# EasyEDA Pro project BlueberryPi.eprj, schematic BlueberryPi Board, sheets 1 to 8 of 13 (continued)
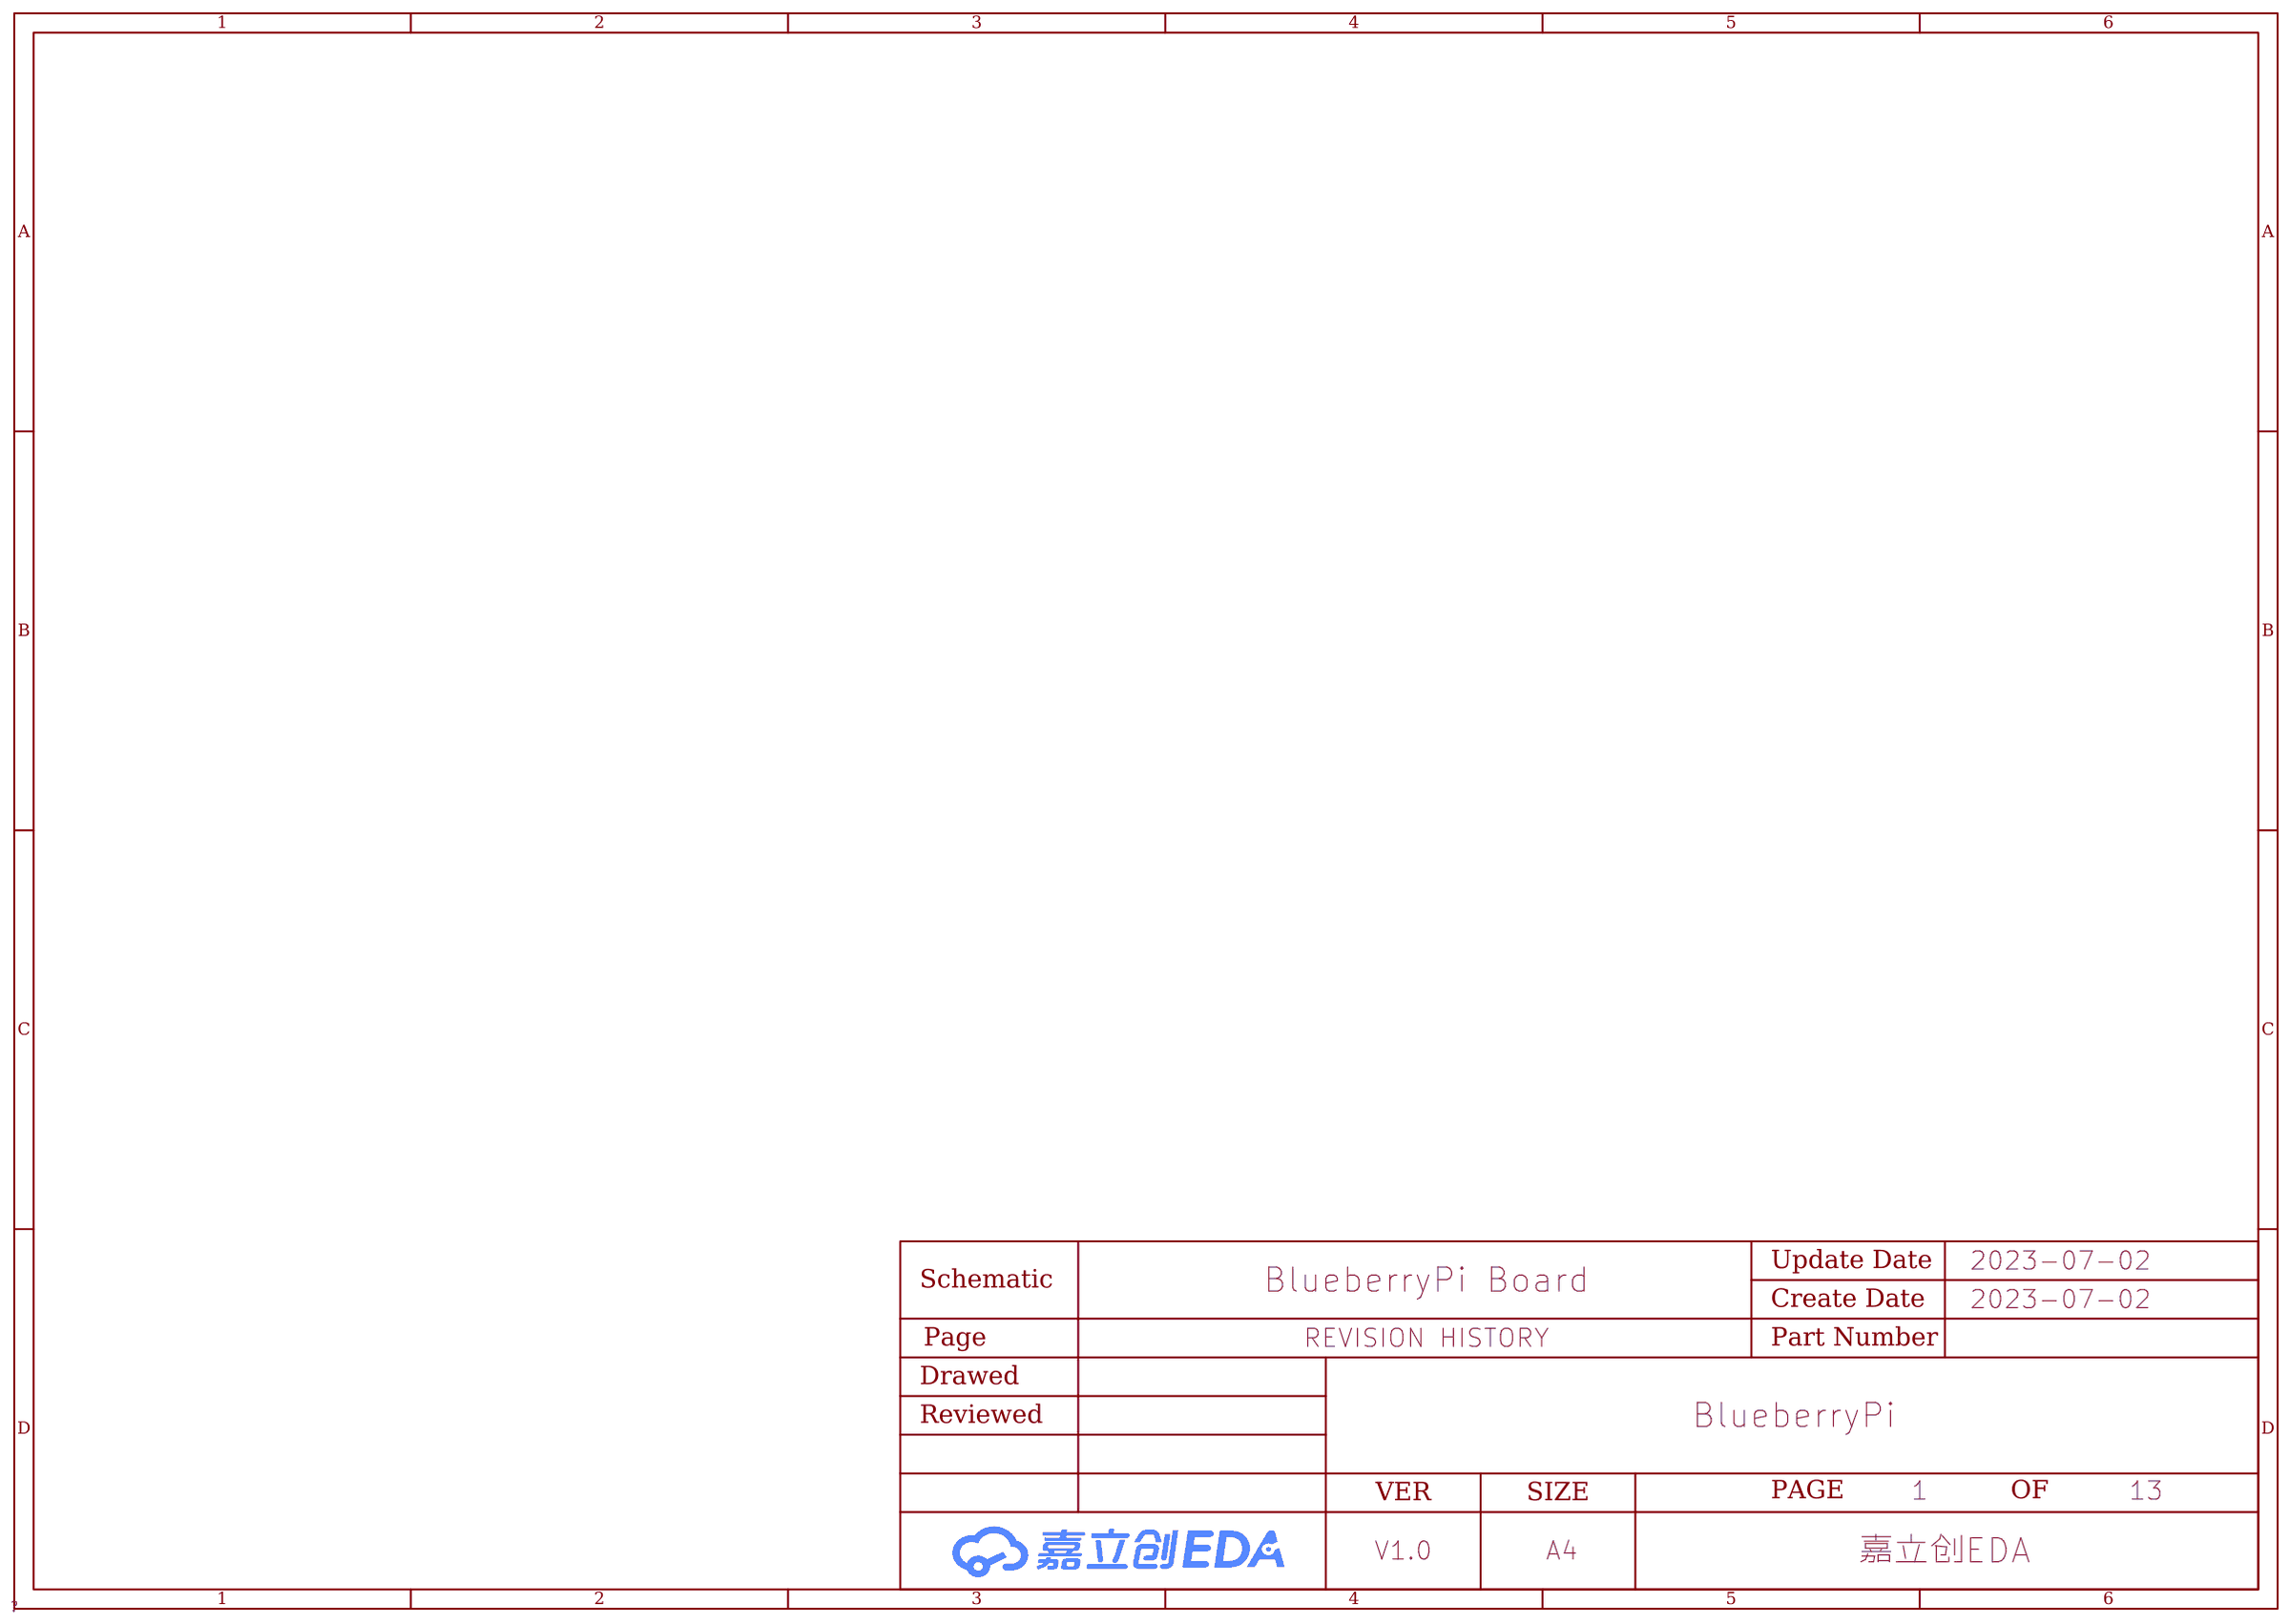
[diagram p0: REVISION HISTORY]
## Nets (continued)
VCC18-RTC: C54.2 C95.2 R13.1 R26.1 R37.1 R38.1 R41.1 U1.F20(VCC-RTC)
VCC33-WIFI: R36.2 ; also on sheet 13
VCC-DCXOIO: C2.2 C4.2 C43.2 R32.1 R35.1 U1.A22(DXVCCIO) U1.H6(VCC-PG) U1.M19(VCC-PM) ; also on sheet 13
VCC-DRAM: C60.2 C61.2 C62.2 C63.2 C64.2 C66.2 C67.2 C68.2 C69.2 C74.2 C75.2 C76.2 C77.2 C78.2 C79.2 C80.2 C81.2 C82.2 C83.2 C84.2 C85.2 C86.2 C87.2 C88.2 C118.2 L5.2 R20.2 R22.2 U1.U8(VCC-DRAM1) U1.U13(VCC-DRAM2) U1.U14(VCC-DRAM3) U1.U16(VCC-DRAM4) U1.V9(VCC-DRAM5) U1.V10(VCC-DRAM6) U1.V11(VCC-DRAM7) U1.V15(VCC-DRAM8) U35.A8(VDD2) U35.A9(VDD2) U35.A11(VDDQ) U35.C12(VDDQ) U35.D4(VDD2) U35.D5(VDD2) U35.D6(VDD2) U35.E8(VDDQ) U35.E12(VDDQ) U35.F2(VDDCA) U35.G2(VDDCA) U35.G5(VDD2) U35.G12(VDDQ) U35.H3(VDDCA) U35.H5(VDD2) U35.H6(VDD2) U35.H8(VDDQ) U35.H9(VDDQ) U35.H11(VDDQ) U35.H12(VDD2) U35.J5(VDD2) U35.J6(VDD2) U35.J9(VDDQ) U35.J10(VDDQ) U35.K5(VDD2) U35.K6(VDD2) U35.K8(VDDQ) U35.K11(VDDQ) U35.K12(VDD2) U35.L2(VDDCA) U35.L5(VDD2) U35.L12(VDDQ) U35.M2(VDDCA) U35.N8(VDDQ) U35.N12(VDDQ) U35.P4(VDD2) U35.P5(VDD2) U35.P6(VDD2) U35.R12(VDDQ) U35.U8(VDD2) U35.U9(VDD2) U35.U11(VDDQ) U37.10(DCDCE)
VCC-PC: C1.2 R33.1 R34.1 U1.N19(VCC-PC) ; also on sheet 9
VDD18-LPDDR: C89.2 C90.2 R26.2 U35.A3(VDD1) U35.A4(VDD1) U35.A5(VDD1) U35.A6(VDD1) U35.A10(VDD1) U35.U3(VDD1) U35.U4(VDD1) U35.U5(VDD1) U35.U6(VDD1) U35.U10(VDD1)
VDD-CPU: C13.2 C14.2 C15.2 C16.2 C17.2 C110.2 C112.2 L1.2 L2.2 U1.L16(VDD-CPU1) U1.L17(VDD-CPU2) U1.M16(VDD-CPU3) U1.M17(VDD-CPU4) U1.N16(VDD-CPU5) U1.N17(VDD-CPU6) U1.P15(VDD-CPU7) U1.P16(VDD-CPU8) U1.P17(VDD-CPU9)
VDD-CPUFB: U1.R16(VDD-CPUFB1) U1.T17(VDD-CPUFB2) U37.39(DCDCB) U37.40(DCDCA)
VDD-CPUS: C10.2 C11.2 C12.2 U1.F19(RTC-VIO) U1.K18(VDD-CPUS)
VDD-GPU: C23.2 C24.2 C25.2 C26.2 C27.2 C114.2 L3.2 U1.L8(VDD-GPU1) U1.M8(VDD-GPU2) U1.M9(VDD-GPU3) U1.N8(VDD-GPU4) U1.N9(VDD-GPU5) U1.P8(VDD-GPU6) U1.P9(VDD-GPU7)
VDD-GPUFB: U1.R7(VDD-GPUFB) U37.47(DCDCC)
VDD-SYS: C18.2 C19.2 C20.2 C21.2 C22.2 C48.2 C50.2 C51.2 C55.2 C116.2 L4.2 U1.D18(VDD09-HDMI) U1.G12(VDD09-PCIE) U1.G13(VDD-SYS1) U1.G14(VDD-SYS2) U1.G16(VDD-USB) U1.H13(VDD-SYS3) U1.H14(VDD-SYS4) U1.J13(VDD-SYS5) U1.J14(VDD-SYS6) U37.9(DCDCD)
AC-AVCC: C35.2 C37.2 U1.D3(AC-AVCC)
AC-LDOIN: C33.2 C34.2 C45.2 C49.2 C99.2 R9.2 R10.2 R11.2 U1.B3(VCC-EPHY) U1.C3(TV-VCC) U1.E4(AC-LDOIN) U37.31(ALDO2)
AC-VDD-IN: C38.2 U1.D5(AC-SYS-VDD-OUT) U1.E6(AC-SYS-VDD-IN)
ALDO1: C3.2 C98.2 R32.2 R39.2 R40.2 U1.H18(VCC-PL) U37.28(ALDO1) ; also on sheet 11
ALDO3: C28.2 C29.2 C56.2 C100.2 C106.2 R5.1 R34.2 U1.E14(VCC-USB) U1.G8(VCC-IO) U1.R6(VCC-PD) U37.19(CLDO1) U37.32(ALDO3) ; also on sheet 9 10 11 12
AP-CK32KO: U1.G20(X32KFOUT) ; also on sheet 13
AP-NMI: C8.1 R38.2 U1.G21(NMI) U37.16(IRQ)
AP-RESET: C7.1 C94.2 R13.2 U1.G22(RESET) U4.2(A) U37.15(PWROK) ; also on sheet 11
AP-WAKE-BT: U1.L22(PM2) ; also on sheet 13
BIAS-ITEST: R15.1 U1.D20(ITEST)
BIAS-REXT: R14.1 U1.D21(REXT)
BIAS-VRAL: C9.1 U1.D19(VRAL)
BLDO1: C46.2 C57.2 C58.2 C59.2 C102.2 R12.2 U1.E19(VCC18-BIAS) U1.P18(VCC-PLL) U1.W22(VDD18-DRAM) U37.2(BLDO1)
BLDO2: C47.2 C52.2 C53.2 C103.2 R33.2 U1.C19(VCC18-HDMI) U1.G11(VDD-EFUSE) U1.H11(VCC-PCIE) U37.1(BLDO2)
BLDO3: C104.2 R35.2 U37.4(BLDO3)
BT-PCM-CLK: U1.K2(PG11/PCM2-CLK/H-PCM2-CLK/SIM0-CLK/BIST-RESULT0) ; also on sheet 13
BT-PCM-DIN: U1.L3(PG12/PCM2-DOUT/H-PCM2-DOUT/SIM0-DATA/BIST-RESULT1) ; also on sheet 13
BT-PCM-DOUT: U1.L4(PG13/PCM2-DIN/H-PCM2-DIN/SIM0-RST/BIST-RESULT2) ; also on sheet 13
BT-PCM-SYNC: U1.K3(PG10/PCM2-SYNC/H-PCM2-SYNC/SIM0-PWREN) ; also on sheet 13
BT-REG-ON: U1.L19(PM4) ; also on sheet 13
BT-UART-CTS: U1.H3(PG8/UART1-RTS/PLL-STA-DB/SIM0-VPPEN) ; also on sheet 13
BT-UART-RTS: U1.K1(PG9/UART1-CTS/PLL-TEST-GPIO/SIM0-VPPPP) ; also on sheet 13
BT-UART-RX: U1.H4(PG6/UART1-TX) ; also on sheet 13
BT-UART-TX: U1.J6(PG7/UART1-RX) ; also on sheet 13
BT-WAKE-AP: U1.L21(PM1) ; also on sheet 13
CLDO2: C107.2 C108.2 R36.1 U37.17(CLDO3) U37.20(CLDO2)
CPUX-URX: U1.D12(PH1/UART0-RX/PCM0-CLK/H-PCM0-CLK/SIM1-VPPPP) ; also on sheet 11
CPUX-UTX: U1.C9(PH0/UART0-TX/PCM0-SYNC/H-PCM0-SYNC/SIM1-VPPEN) ; also on sheet 11
DCXO-LDOOUT: C44.2 U1.D22(DXLDO_OUT)
DCXO-XIN: C39.1 U1.B23(XIN) X1.1(OSC1)
DCXO-XOUT: R16.1 U1.B22(XOUT)
DDC_CEC_EN: U1.E11(PH2/IR-TX/PCM0-DOUT/H-PCM0-DOUT/SIM1-PWREN) ; also on sheet 12
EMMC-CLK: R1.1 ; also on sheet 9
EMMC-CMD: U1.M21(PC5/NAND-RB0/SDC2-CMD/SPI0-CS) ; also on sheet 9
EMMC-D0: U1.N22(PC6/NAND-DQ0/SDC2-D0/SPI0-HOLD) ; also on sheet 9
EMMC-D1: U1.N23(PC7/NAND-DQ1/SDC2-D1/SPI0-WP) ; also on sheet 9
EMMC-D2: U1.R22(PC8/NAND-DQ2/SDC2-D2) ; also on sheet 9
EMMC-D3: U1.R23(PC9/NAND-DQ3/SDC2-D3) ; also on sheet 9
EMMC-D4: U1.T22(PC10/NAND-DQ4/SDC2-D4) ; also on sheet 9
EMMC-D5: U1.T21(PC11/NAND-DQ5/SDC2-D5) ; also on sheet 9
EMMC-D6: U1.U19(PC12/NAND-DQ6/SDC2-D6) ; also on sheet 9
EMMC-D7: U1.U21(PC13/NAND-DQ7/SDC2-D7) ; also on sheet 9
EMMC-DS: U1.R20(PC1/NAND-ALE/SDC2-DS) ; also on sheet 9
EMMC-RST: R2.1 ; also on sheet 9
HCEC: U1.E9(PH10/HCEC) ; also on sheet 12
HHPD: U1.C20(HHPD) ; also on sheet 12
HOST3_DM: U1.A12(USB3-DM) ; also on sheet 10
HOST3_DP: U1.B12(USB3-DP) ; also on sheet 10
HSCL: U1.E10(PH8/HSCL) ; also on sheet 12
HSDA: U1.F7(PH9/HSDA) ; also on sheet 12
HTX0N: U1.B19(HTX0N) ; also on sheet 12
HTX0P: U1.A19(HTX0P) ; also on sheet 12
HTX1N: U1.B18(HTX1N) ; also on sheet 12
HTX1P: U1.A18(HTX1P) ; also on sheet 12
HTX2N: U1.B17(HTX2N) ; also on sheet 12
HTX2P: U1.A17(HTX2P) ; also on sheet 12
HTXCN: U1.B20(HTXCN) ; also on sheet 12
HTXCP: U1.A20(HTXCP) ; also on sheet 12
KEYADC: C30.2 R12.1 U1.B21(KEYADC)
LINEOUTL: U1.D2(LINEOUTL) ; also on sheet 12
LINEOUTR: U1.D1(LINEOUTR) ; also on sheet 12
PD15: U1.R3(PD15/LCD0-D21/TS1-DVLD/DMIC-DATA0/CSI-D9) ; also on sheet 9
PD16: U1.R2(PD16/LCD0-D22/TS1-D0/DMIC-DATA1) ; also on sheet 9
PD18: U1.P4(PD18/LCD0-CLK/TS2-ERR/DMIC-DATA3) ; also on sheet 9
PD21: U1.T3(PD21/LCD0-VSYNC/TS2-D0/UART2-RTS) ; also on sheet 9
PL8: U1.H22(PL8/S-PWM0) ; also on sheet 9
PL10: U1.H21(PL10/S-OWC/S-PWM1) ; also on sheet 9
PMU-SCK: R39.1 U1.K20(PL0/S-RSB-SCK/S-TWI-SCK) U37.23(SCK)
PMU-SDA: R40.1 U1.K23(PL1/S-RSB-SDA/S-TWI-SDA) U37.24(SDA)
PS: C91.2 C92.2 C93.2 C97.2 C101.2 C105.2 C109.1 C111.1 C113.1 C115.1 C117.1 D1.1(C) U37.3(BLDOIN) U37.6(VIND) U37.13(VINE) U37.18(CLDOIN) U37.30(ALDOIN) U37.33(VINB_1) U37.34(VINB_2) U37.45(VINA_2) U37.46(VINA_1) U37.52(VINC_2) U37.53(VINC_1) USB1.1(VBUS) ; also on sheet 9 10 12 13
PWM0: U1.U2(PD22/PWM0/TS3-CLK/UART2-CTS) ; also on sheet 9
PWR-LED: U1.K21(PL4/S-JTAG-MS) ; also on sheet 11
PWRON: U37.27(EN/PWRON) U38.1 ; also on sheet 11
RECOVERY: U1.J22(PL5/S-JTAG-CK) ; also on sheet 11
S-UART-RX: U1.J20(PL3/S-UART-RX) ; also on sheet 9
S-UART-TX: U1.K22(PL2/S-UART-TX) ; also on sheet 9
SA0: U1.AA15(SA0) U35.R2(CA0)
SA1: U1.AA17(SA1) U35.P2(CA1)
SA2: U1.AA19(SA2) U35.N2(CA2)
SA3: U1.Y20(SA3) U35.N3(CA3)
SA4: U1.Y16(SA4) U35.M3(CA4)
SA5: U1.Y10(SA5) U35.F3(CA5)
SA6: U1.Y8(SA6) U35.E3(CA6)
SA7: U1.AA5(SA7) U35.E2(CA7)
SA8: U1.AA7(SA8) U35.D2(CA8)
SA9: U1.Y3(SA9) U35.C2(CA9)
SCKE0: U1.W14(SCKE0) U35.K3(CKE0)
SCKE1: U1.Y11(SCKE1) U35.K4(CKE1)
SCKN: R24.2 U1.AB12(SCKN) U35.J2(CK_c)
SCKP: R24.1 U1.AC12(SCKP) U35.J3(CK_t)
SCS0: U1.W13(SCS0) U35.L3(CS0_n)
SCS1: U1.Y14(SCS1) U35.L4(CS1_n)
SDC0-CLK: R94.2 ; also on sheet 10
SDC0-CMD: U1.G3(PF3/SDC0-CMD/JTAG-DO1) ; also on sheet 10
SDC0-D0: U1.F3(PF1/SDC0-D0/JTAG-DI1) ; also on sheet 10
SDC0-D1: U1.E2(PF0/SDC0-D1/JTAG-MS1) ; also on sheet 10
SDC0-D2: U1.G2(PF5/SDC0-D2/JTAG-CK1) ; also on sheet 10
SDC0-D3: U1.F1(PF4/SDC0-D3/UART0-RX) ; also on sheet 10
SDC0-DET: U1.C8(PF6) ; also on sheet 10
SDQ0: U1.AB18(SDQ0) U35.P9(DQ0)
SDQ1: U1.AC17(SDQ1) U35.M8(DQ4)
SDQ2: U1.AB17(SDQ2) U35.N9(DQ1)
SDQ3: U1.AC16(SDQ3) U35.N10(DQ2)
SDQ4: U1.AB15(SDQ4) U35.N11(DQ3)
SDQ5: U1.AB14(SDQ5) U35.M9(DQ5)
SDQ6: U1.AC14(SDQ6) U35.M10(DQ6)
SDQ7: U1.AC13(SDQ7) U35.M11(DQ7)
SDQ8: U1.AB19(SDQ8) U35.R11(DQ23)
SDQ9: U1.AC20(SDQ9) U35.T11(DQ19)
SDQ10: U1.AC21(SDQ10) U35.T10(DQ18)
SDQ11: U1.AB20(SDQ11) U35.R10(DQ22)
SDQ12: U1.AB23(SDQ12) U35.T9(DQ17)
SDQ13: U1.AA23(SDQ13) U35.R9(DQ21)
SDQ14: U1.AA22(SDQ14) U35.T8(DQ16)
SDQ15: U1.Y22(SDQ15) U35.R8(DQ20)
SDQ16: U1.AC6(SDQ16) U35.E9(DQ14)
SDQ17: U1.AB6(SDQ17) U35.F8(DQ11)
SDQ18: U1.AC7(SDQ18) U35.F9(DQ10)
SDQ19: U1.AB7(SDQ19) U35.D9(DQ15)
SDQ20: U1.AC9(SDQ20) U35.F10(DQ9)
SDQ21: U1.AB9(SDQ21) U35.E10(DQ13)
SDQ22: U1.AC10(SDQ22) U35.F11(DQ8)
SDQ23: U1.AB10(SDQ23) U35.E11(DQ12)
SDQ24: U1.Y1(SDQ24) U35.C8(DQ27)
SDQ25: U1.Y2(SDQ25) U35.B8(DQ31)
SDQ26: U1.AA1(SDQ26) U35.C9(DQ26)
SDQ27: U1.AA2(SDQ27) U35.B9(DQ30)
SDQ28: U1.AC2(SDQ28) U35.B10(DQ29)
SDQ29: U1.AC3(SDQ29) U35.B11(DQ28)
SDQ30: U1.AC4(SDQ30) U35.C11(DQ24)
SDQ31: U1.AB4(SDQ31) U35.C10(DQ25)
SDQM0: U1.AC18(SDQM0) U35.L8(DM0)
SDQM1: U1.Y23(SDQM1) U35.P8(DM2)
SDQM2: U1.AB11(SDQM2) U35.G8(DM1)
SDQM3: U1.AB5(SDQM3) U35.D8(DM3)
SDQS0N: U1.AB16(SDQS0N) U35.L11(DQS0_c)
SDQS0P: U1.AC15(SDQS0P) U35.L10(DQS0_t)
SDQS1N: U1.AB22(SDQS1N) U35.P11(DQS2_c)
SDQS1P: U1.AC22(SDQS1P) U35.P10(DQS2_t)
SDQS2N: U1.AC8(SDQS2N) U35.G11(DQS1_c)
SDQS2P: U1.AB8(SDQS2P) U35.G10(DQS1_t)
SDQS3N: U1.AB2(SDQS3N) U35.D11(DQS3_c)
SDQS3P: U1.AB1(SDQS3P) U35.D10(DQS3_t)
SODT0: U1.AA13(SODT0) U35.J8(ODT1)
SPI1-CLK: U1.E12(PH4/SPI1-CLK/PCM0-MCLK/H-PCM0-MCLK/SIM1-DATA) ; also on sheet 9
SPI1-CS: U1.D11(PH3/SPI1-CS/PCM0-DIN/H-PCM0-DIN/SIM1-CLK) ; also on sheet 9
SPI1-MISO: U1.D9(PH6/SPI1-MISO/SPDIF-IN/TWI1-SDA/SIM1-DET) ; also on sheet 9
SPI1-MOSI: U1.F9(PH5/SPI1-MOSI/SPDIF-MCLK/TWI1-SCK/SIM1-RST) ; also on sheet 9
STATUS-LED: U1.J21(PL7/S-JTAG-DI) ; also on sheet 11
SVREF: C65.2 C70.2 C71.2 C73.2 R20.1 R21.2 U1.V6(SVREF) U35.H4(VRef(CA))
SVREF_DQ: C72.2 R22.1 R23.2 U35.J11(VRef(DQ))
TWI0-SCK: U1.U3(PD25/TWI0-SCK/TS3-DVLD/UART3-RTS/JTAG-DO) ; also on sheet 9
TWI0-SDA: U1.R5(PD26/TWI0-SDA/TS3-D0/UART3-CTS/JTAG-DI) ; also on sheet 9
UART3-RX: U1.V1(PD24/TWI2-SDA/TS3-SYNC/UART3-RX/JTAG-CK) ; also on sheet 9
UART3-TX: U1.U5(PD23/TWI2-SCK/TS3-ERR/UART3-TX/JTAG-MS) ; also on sheet 9
UBOOT: U1.G17(UBOOT) ; also on sheet 11
USB0-DM: U1.A13(USB0-DM) ; also on sheet 10
USB0-DP: U1.B13(USB0-DP) ; also on sheet 10
USB1-DM: U1.B16(USB1-DM) ; also on sheet 10
USB1-DP: U1.C16(USB1-DP) ; also on sheet 10
USB1-SSRXN: U1.A14(USB1-SSRXN) ; also on sheet 10
USB1-SSRXP: U1.B14(USB1-SSRXP) ; also on sheet 10
USB1-SSTXN: C5.1 ; also on sheet 10
USB1-SSTXP: C6.1 ; also on sheet 10
VRA1: C32.2 U1.C4(VRA1)
VRA2: C31.2 U1.D4(VRA2)
VREF: C96.2 U37.29(VREF)
WIFI-PWR-EN: U1.F8(PH7/SPDIF-OUT) ; also on sheet 13
WL-REG-ON: U1.M22(PM3) ; also on sheet 13
WL-SDIO-CLK: R7.2 ; also on sheet 13
WL-SDIO-CMD: U1.J3(PG1/SDC1-CMD) ; also on sheet 13
WL-SDIO-D0: U1.J5(PG2/SDC1-D0) ; also on sheet 13
WL-SDIO-D1: U1.H2(PG3/SDC1-D1) ; also on sheet 13
WL-SDIO-D2: U1.L5(PG4/SDC1-D2) ; also on sheet 13
WL-SDIO-D3: U1.H5(PG5/SDC1-D3) ; also on sheet 13
WL-WAKE-AP: U1.L20(PM0) ; also on sheet 13
X32KI: C41.1 R17.2 U1.F23(X32KIN) X2.4(OSC2)
X32KO: C42.1 R17.1 U1.F22(X32KOUT) X2.1(OSC1)
$C5_2: C5.2 U1.B15(USB1-SSTXN)
$C6_2: C6.2 U1.C15(USB1-SSTXP)
$C40_1: C40.1 R16.2 X1.3(OSC2)
$L1_1: L1.1 U37.43(LXA_2) U37.44(LXA_1)
$L2_1: L2.1 U37.35(LXB_1) U37.36(LXB_2)
$L3_1: L3.1 U37.50(LXC_2) U37.51(LXC_1)
$L4_1: L4.1 U37.7(LXD)
$L5_1: L5.1 U37.12(LXE)
$R1_2: R1.2 U1.N20(PC4/NAND-RE/SDC2-CLK)
$R2_2: R2.2 U1.R19(PC14/NAND-DQS/SDC2-RST)
$R3_1: R3.1 R4.2
$R3_2: R3.2 U1.P19(PC15/NAND-CE1)
$R4_1: R4.1 R5.2
$R7_1: R7.1 U1.J2(PG0/SDC1-CLK)
$R8_2: R8.2 U1.B4(EPHY-RTX)
$R9_1: R9.1 U1.E8(TEST1)
$R10_1: R10.1 U1.C7(TEST2)
$R11_1: R11.1 U1.E7(TEST3)
$R18_2: R18.2 U1.W2(SZQ)
$R19_1: R19.1 U35.B3(ZQ)
$R37_2: R37.2 U37.26(PHSET)
$R41_2: R41.2 U37.25(VINT)
$R94_1: R94.1 U1.F2(PF2/SDC0-CLK/UART0-TX)

Not connected (* = marked no-connect by the designer): U1 A3(TV-OUT)* A5(EPHY-TXP)* A6(EPHY-RXP)* A8(PCIE-REF-CLKP)* A9(PCIE-TXP)* A10(PCIE-RXP)* AA3(SRST)* AA10(SODT1)* B1(MIC2P)* B2(MIC2N)* B5(EPHY-TXN)* B6(EPHY-RXN)* B7(EPHY-LNK-LED)* B8(PCIE-REF-CLKM)* B9(PCIE-TXM)* B10(PCIE-RXM)* C1(MIC1P)* C2(MIC1N)* C5(EPHY-SPD-LED)* C23(REFCLK_OUT)* D15(HSIC-STR)* D16(HSIC-VCC)* E17(HSIC-DAT)* E21(CLOCK-SELECT)* E22(WREQIN)* F5(MBIAS)* F11(JTAGSEL0)* G10(JTAGSEL1)* H17(BOOT-SELECT)* H19(TEST)* H20(PL6/S-JTAG-DO)* J19(PL9/S-IR-RX)* L2(PG14/PCM2-MCLK/H-PCM2-MCLK/SIM0-DET/BIST-RESULT3)* L6(PD2/LCD0-D4/TS0-SYNC/CSI-HSYNC/RGMII-RXD1/RMII-RXD1)* M2(PD4/LCD0-D6/TS0-D0/CSI-D0/RGMII-RXCK/RMII-NULL)* M3(PD1/LCD0-D3/TS0-ERR/CSI-MCLK/RGMII-RXD2/RMII-NULL)* M4(PD5/LCD0-D7/TS0-D1/CSI-D1/RGMII-RXCTL/RMII-CRS-DV)* M5(PD3/LCD0-D5/TS0-DVLD/CSI-VSYNC/RGMII-RXD0/RMII-RXD0)* M6(PD10/LCD0-D14/TS0-D6/CSI-D6/RGMII-TXD0/RMII-TXD0)* N2(PD6/LCD0-D10/TS0-D2/CSI-D2/RGMII-NULL/RMII-RXER)* N3(PD0/LCD0-D2/TS0-CLK/CSI-PCLK/RGMII-RXD3/RMII-NULL)* P1(PD11/LCD0-D15/TS0-D7/CSI-D7/RGMII-TXCK/RMII-TXCK)* P2(PD9/LCD0-D13/TS0-D5/CSI-D5/RGMII-TXD1/RMII-TXD1)* P3(PD19/LCD0-DE/TS2-SYNC/UART2-TX/MDC)* P5(PD8/LCD0-D12/TS0-D4/CSI-D4/RGMII-TXD2/RMII-NULL)* P6(PD13/LCD0-D19/TS1-ERR/CSI-SDA/RGMII-CLKIN/RMII-NULL)* P21(PC16/NAND-RB1)* P22(PC2/NAND-CLE/SPI0-MOSI)* R21(PC0/NAND-WE/SPI0-CLK)* T1(PD7/LCD0-D11/TS0-D3/CSI-D3/RGMII-TXD3/RMII-NULL)* T2(PD17/LCD0-D23/TS2-CLK/DMIC-DATA2)* T20(PC3/NAND-CE0/SPI0-MISO)* U4(PD14/LCD0-D20/TS1-SYNC/DMIC-CLK/CSI-D8)* V2(PD12/LCD0-D18/TS1-CLK/CSI-SCK/RGMII-TXCTL/RMII-TXEN)* V3(PD20/LCD0-HSYNC/TS2-DVLD/UART2-RX/MDIO)* V21(PLLTEST)* V22(X24MIN)* V23(X24MOUT)* W4(SPAR)* W11(SBG1)* Y21(SALERT)*; U35 A1(DNU)* A2(DNU)* A12(DNU)* A13(DNU)* B1(DNU)* B4(NC)* B13(DNU)* C4(NC)* K9(NC)* R3(NC)* T1(DNU)* T13(DNU)* U1(DNU)* U2(DNU)* U12(DNU)* U13(DNU)*; U37 5(BLDO4)* 14(GPIO(WAKEUP))* 21(SWIN)* 22(SWOUT)* 55(MODESET)* 56(DCBSET)*; USB1 2(D-)* 3(D+)* 4(ID)*

## Notes on the sheets
sheet 2
- HDMI Port
- 5V/2A
- Power
  System
- EPHY
- PCIe
- SPDIF
- HDMI
- LINE
  OUT
- Audio(R/L)
- POWER
- HP JACK
- VIDEO
- EMMC
- EMMC/
  NAND
- USB0
- USB OTG
- USB2.0
- LPDDR3
    (2GB)
- DRAMC
- USB1
- USB Host
- USB3.0
- SDIO
- H6
- WIFI ANT
- WIFI+BT
- USB3
- USB Host
- USB2.0
- BT
- SDC0
- TF Card
- 24MHz
- DCXO
- 32KHz Clock
- OSC
- IR RX
- GPIO
- UART0
- 32KHz
- KEY
- LED
- GPIO
- DEBUG
- 注：浅色文字模块表示H6主控有该功能，但未被开发板使用
sheet 3
- AXP805
- (ON) 默认打开
- (OFF) 默认关闭
- 5V@2A
- DCIN
- VIN
- VINT
- 1.8V@100mA
- 1.8V RTC/LPDDR (ON)
- DC/DCA
- DC/DCB
- 0.6V-1.52V@5A
- 0.9V CPU(ON)
- 0.6V-1.52V@2.5A
- DC/DCC
- 0.9V VDD-GPU(ON)
- 0.6V-3.3V@1.5A
- DC/DCD
- 0.9V SYS/USB/HDMI/PCIE(ON)
- 0.6V-3.3V@1.5A
- DC/DCE
- 1.2V DRAM(LPDDR3) (ON)
- 100mΩ from VBAT
- SWOUT
- 0.7V-3.3V@300mA
- ALDO1
- 3.3V PL/LED/IR(ON)
- 0.7V-3.3V@300mA
- ALDO2
- 3.3V AC-LDOIN/AUDIO/TV/EPHY/MAC(OFF)
- 0.7V-3.3V@300mA
- ALDO3
- 3.3V和CLDO1并联(OFF)
- 0.7V-1.9V@400mA
- BLDO1
- 1.8V DDR/BIAS/PLL(ON)
- 0.7V-1.9V@300mA
- BLDO2
- 1.8V HDMI/PCIE/PC/EFUSE(ON)
- 0.7V-1.9V@200mA
- BLDO3
- 1.8V(OFF)
- BLDO4
- 0.7V-1.9V@200mA
- 1.8V(OFF)
- 0.7V-3.3V@400mA
- CLDO1
- 3.3V IO/eMMC/CARD/PD/USB/UART(ON)
- CLDO2
- 0.7V-3.3V@300mA
- 3.3V(OFF)
- 0.7V-3.3V@200mA
- CLDO3
- 3.3V(OFF)
- 3.3V@1A
- 1.8V@300mA
- DCDC
- LDO
- 1.8V WIFI-IO/PG/PM/DCXO(ON)
- 3.3V WIFI-CORE(ON)
sheet 5
- 此处有一个不焊接的电容，我没加
- 此模块为eMMC存储
- 此模块为SD卡
- 这部分原厂和OrangePi不一样，不焊0Ω电阻为
  原厂方案，焊为OrangePi方案
- 此模块为WiFi+蓝牙
- 注意：这里的UART收发是经过交叉的
- 以太网口，没画
- DEBUG
- 与计算机进行串口通信
- HDMI控制端
- SPI通信
- WiFi模组供电使能
- HDMI控制端
- 电源芯片数据及时钟线
- OrangePi中作为GPIO中串口通信线
- GPIO
- 电源指示灯
- 状态指示灯
- GPIO
- OrangePi上为红外接收模块，我去除了
- GPIO
- WiFi、蓝牙相关
- 电源滤波
sheet 6
- 电源芯片控制端
- PCIE模块，未使用
- 香橙派上是测试点，原厂为按钮
- USB模块
- 晶振
- 原厂上是测试点，香橙派为悬空
- HDMI模块
- 晶振
- 接电源芯片
- 音频输出接口不带视频功能
- 麦克风接口，不加麦克风
- 数字音频接口
- 信号远离板边以及干扰信号，做包地处理
- 信号远离板边以及干扰信号，做包地处理
- 原厂为测试点，香橙派为悬空
- DXCO
- OSC-RTC
- 放置在RTC-VIO附近
sheet 7
- 休眠不掉电
- 数据线
- 地址线
- 数据锁存、数据源码
- 控制线
- 休眠掉电
- OrangePi这里是
  VDD18-LPDDR，
  怀疑有错
- 放置在靠近过孔换层的地方
- 默认不贴
- 放置在靠近SOC的地方
- 默认不贴
- 放置在靠近LPDDR的地方
sheet 8
- DCIN
- PMIC
- 0.9V
- 0.9V
- 1.8V
- 0.9V
- DC-DC
- modeset floating表示self-work模式
- 1.2V
- 5.0V
- 此处尽量加粗
- 测试点
- 电源芯片控制端
- 此处尽量加粗
- LDO
- 3.3V
- 1.8V
- 3.3V
- 1.8V
- 1.8V
- 3.3V
- 3.3V
